# EasyEDA Pro project DualModeKeyboard.eprj (continued)
## Notes on the sheet (continued)
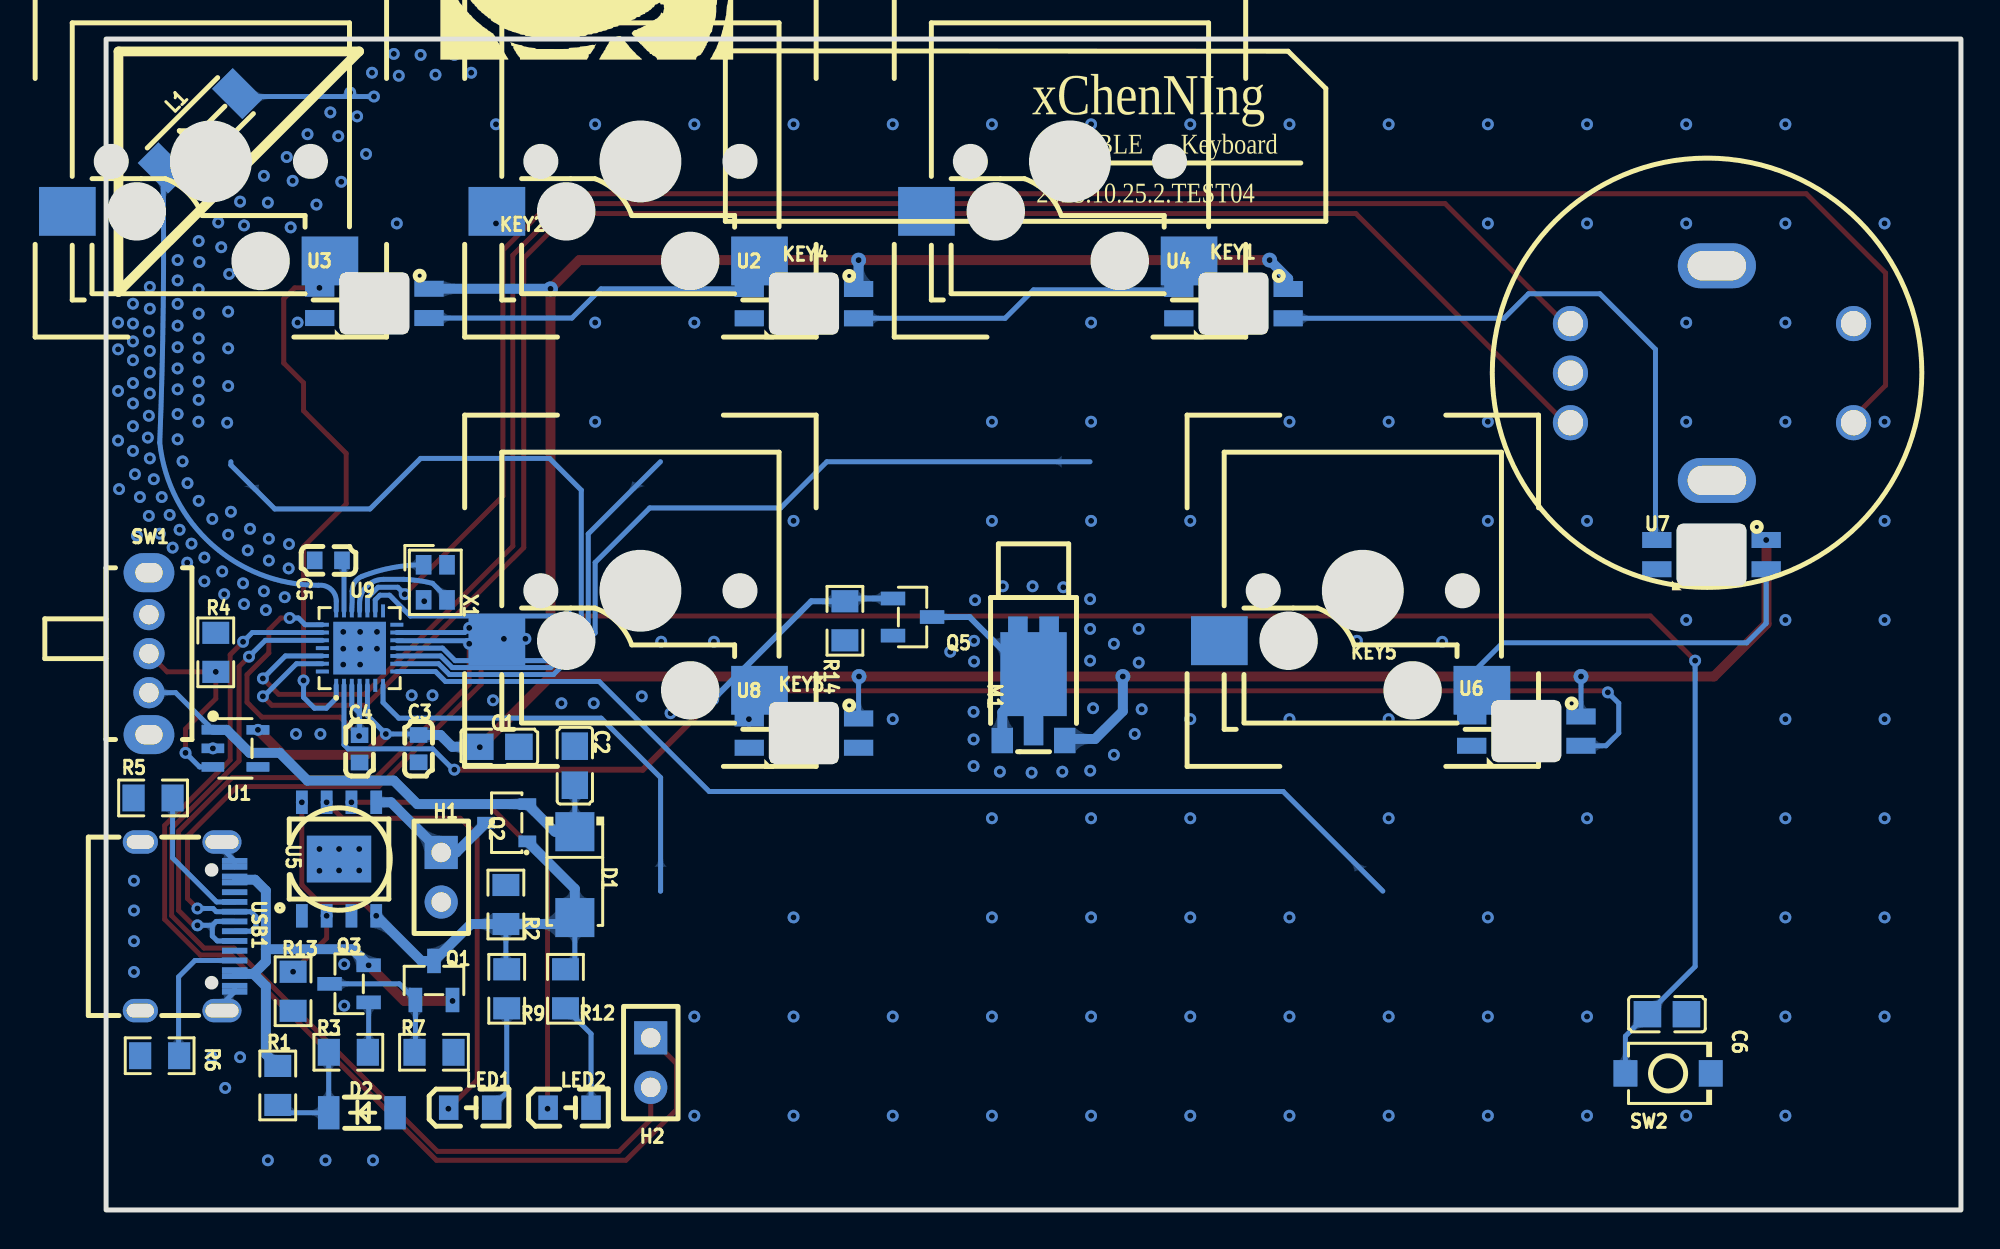
[diagram p2: board, bottom side, seen from below]

Outline 95.63 x 60 mm; copper layers: Top Layer, Bottom Layer. Coordinates in mm from the lower left corner of the outline.
Outline path: rectangle 0,60 95,0
Stack: Top Layer 0.035mm / Dielectric1 1.51mm FR4 er 4.5 / Bottom Layer 0.035mm

## Design rules (mm)
template: JLCPCB Capability(Two Layers Board)
spacing copperThickness1oz (default): track to track 0.102, other pairs 0.152 to 0.3
spacing copperThickness2oz: track to track 0.203, other pairs 0.152 to 0.3
track width copperThickness1oz (default): min 0.127, default 0.254, max 2.54
track width copperThickness2oz: min 0.203, default 0.254, max 2.54
differential pair differentialPair (default): width min 0.127, default 0.254, max 2.54; gap min 0.152, default 0.152
via viaSize (default): diameter min 0.5, default 0.61, max 10; hole min 0.3, default 0.305, max 6.3

## Placement (name value [footprint] x y rotation side)
C1  1uf  [C0805]  74.86 23.73 0 bottom
C2  4.7uf  [C0805]  70.99 22.76 270 bottom
C3  100nF  [C0603]  78.99 23.64 90 bottom
C4  100nF  [C0603]  82.02 23.63 270 bottom
C5  100nF  [C0603]  83.62 33.29 0 bottom
C6  0.1uf  [C0805]  15.06 10.03 0 bottom
D1  SS24  [SMA_L4.3-W2.6-LS5.2-RD]  70.99 17.18 270 bottom
D2  ZMM5V1  [LL-34_L3.5-W1.5-RD]  81.9 4.98 180 bottom
H1  BT_3V7  [HDR-TH_2P-P2.54-V-F]  77.84 17.05 270 bottom
H2  -  [HDR-TH_2P-P2.54-V-F]  67.11 7.55 270 bottom
KEY1  CPG151101S11  [AxisSeat_14_18_XCN1]  46.26 49.9 180 bottom
KEY2  CPG151101S11  [AxisSeat_14_18_XCN1]  90.26 49.9 180 bottom
KEY3  CPG151101S11  [AxisSeat_14_18_XCN1]  68.26 27.9 180 bottom
KEY4  CPG151101S11  [AxisSeat_14_18_XCN1]  68.26 49.9 180 bottom
KEY5  CPG151101S11  [AxisSeat_14_18_XCN1]  31.26 27.9 180 bottom
L1  AN2051-245  [ANT2051]  90.17 55.3 135 bottom
LED1  -  [LED_0805]  76.3 5.24 180 bottom
LED2  -  [LED_0805]  71.21 5.24 180 bottom
M1  Z3OC1T8219731  [VIBRATING-MOTOR-SMD_3P-C9900001680]  47.5 25.58 270 bottom
Q1  FMMT718  [SOT-23-3_L2.9-W1.3-P1.90-LS2.4-BR]  78.21 11.76 270 bottom
Q2  AO3401  [SOT-23-3_L2.9-W1.4-P1.90-LS2.6-BR]  74.48 19.84 180 bottom
Q3  FMMT718  [SOT-23-3_L2.9-W1.3-P1.90-LS2.4-BR]  82.55 11.59 180 bottom
Q5  -  [SOT-23-3_L2.9-W1.3-P1.90-LS2.4-BR]  53.7 30.38 0 bottom
R1  2.2K  [R0805]  86.21 6.38 90 bottom
R2  10K  [R0805]  74.52 15.65 90 bottom
R3  1K  [R0805]  82.59 8.08 0 bottom
R4  100K  [R0805]  89.38 28.57 270 bottom
R5  5.1K  [R0805]  92.59 21.11 180 bottom
R6  5.1K  [R0805]  92.26 7.9 180 bottom
R7  6.8K  [R0805]  78.21 8.08 0 bottom
R9  10K  [R0805]  74.48 11.33 90 bottom
R12  10K  [R0805]  71.47 11.33 90 bottom
R13  2.4K  [R0805]  85.42 11.21 90 bottom
R14  10K  [R0805]  57.16 30.19 90 bottom
SW1  SK12D07VG3  [SW-TH_SK12D07VG3]  92.8 28.51 270 bottom
SW2  TS-1088R-02026  [SW-SMD_L3.9-W3.0-P4.45]  15 7 180 bottom
SW3  EC11E18244AU  [SW-TH_EC11XXXXXXXX]  12.75 42.88 90 top
U1  RT9013-33GB  [SOT-23-5_L3.0-W1.7-P0.95-LS2.8-BL]  88.38 23.65 270 bottom
U2  SK6812MINI-E  [LED-SMD_L3.2-W2.8-TR]  59.26 46.44 180 bottom
U3  SK6812MINI-E  [LED-SMD_L3.2-W2.8-TR]  81.26 46.45 180 bottom
U4  SK6812MINI-E  [LED-SMD_L3.2-W2.8-TR]  37.26 46.44 180 bottom
U5  TP4056  [ESOP-8_L4.9-W3.9-P1.27-LS6.0-BL-EP]  83.07 17.98 180 bottom
U6  SK6812MINI-E  [LED-SMD_L3.2-W2.8-TR]  22.26 24.54 180 bottom
U7  SK6812MINI-E  [LED-SMD_L3.2-W2.8-TR]  12.78 33.58 180 bottom
U8  SK6812MINI-E  [LED-SMD_L3.2-W2.8-TR]  59.26 24.44 180 bottom
U9  CH573F  [QFN-28_L4.0-W4.0-P0.40-BL-EP]  82.02 28.79 180 bottom
USB1  KH-TYPE-C-16P-T  [USB-C-SMD_KH-TYPE-C-16P]  90.83 14.53 270 bottom
X1  32MHz  [OSC-SMD_4P-L2.0-W1.6-BL]  78.14 32.16 270 bottom

## Footprints (pads in the part's own frame, mm; a bottom-side part is the same pattern mirrored in y, then rotated)
ANT2051
  rect 1.5x2.2 smd: 1(-2.69,0) 2(2.69,0)
AxisSeat_14_18_XCN1
  rect 2.9x2.5 smd: 1(-6.725,1.27) 2(6.725,-1.27)
C0603
  rect 0.8x0.9 smd: 1(-0.7,0) 2(0.7,0)
C0805
  rect 1.41x1.35 smd: 1(-1,0) 2(1,0)
ESOP-8_L4.9-W3.9-P1.27-LS6.0-BL-EP
  rect 0.6x1.2 smd: 1(-1.905,-2.909) 2(-0.635,-2.909) 3(0.635,-2.909) 4(1.905,-2.909) 5(1.905,2.909) 6(0.635,2.909) 7(-0.635,2.909) 8(-1.905,2.909)
  rect 3.3x2.4 smd: 9(0,0)
HDR-TH_2P-P2.54-V-F
  rect 1.7x1.7 hole 1: 1(-1.27,0)
  round 1.7 hole 1: 2(1.27,0)
LED-SMD_L3.2-W2.8-TR
  rect 1.5x0.82 smd: 1(2.8,0.75) 2(2.8,-0.75) 3(-2.8,-0.75) 4(-2.8,0.75)
LED_0805
  rect 1x1.25 smd: 1(-1.15,0.005) 2(1.05,0.005)
LL-34_L3.5-W1.5-RD
  rect 1.1x1.7 smd: 1(-1.7,0) 2(1.7,0)
OSC-SMD_4P-L2.0-W1.6-BL
  rect 1x0.8 smd: 1(-0.9,-0.6) 2(0.9,-0.6) 3(0.9,0.6) 4(-0.9,0.6)
QFN-28_L4.0-W4.0-P0.40-BL-EP
  rect 0.2x0.665 smd: 1(-1.2,-1.907) 2(-0.8,-1.907) 3(-0.4,-1.907) 4(0,-1.907) 5(0.4,-1.907) 6(0.8,-1.907) 7(1.2,-1.907) 15(1.2,1.907) 16(0.8,1.907) 17(0.4,1.907) 18(0,1.907) 19(-0.4,1.907) 20(-0.8,1.907) 21(-1.2,1.907)
  rect 0.665x0.2 smd: 8(1.907,-1.2) 9(1.907,-0.8) 10(1.907,-0.4) 11(1.907,0) 12(1.907,0.4) 13(1.907,0.8) 14(1.907,1.2) 22(-1.907,1.2) 23(-1.907,0.8) 24(-1.907,0.4) 25(-1.907,0) 26(-1.907,-0.4) 27(-1.907,-0.8) 28(-1.907,-1.2)
  rect 2.7x2.7 smd: 29(0,0)
R0805
  rect 1.133x1.377 smd: 1(-1,0) 2(1,0)
SMA_L4.3-W2.6-LS5.2-RD
  rect 2x2 smd: 1(-2.2,0) 2(2.2,0)
SOT-23-3_L2.9-W1.3-P1.90-LS2.4-BR
  rect 1.25x0.7 smd: 1(1,-0.95) 2(1,0.95) 3(-1,0)
SOT-23-3_L2.9-W1.4-P1.90-LS2.6-BR
  rect 0.91x0.6 smd: 1(1.055,-0.955) 2(1.055,0.955) 3(-1.055,0)
SOT-23-5_L3.0-W1.7-P0.95-LS2.8-BL
  rect 0.49x1.157 smd: 1(-0.95,-1.153) 2(0,-1.153) 3(0.95,-1.153)
  rect 0.49x1.175 smd: 4(0.95,1.153) 5(-0.95,1.153)
SW-SMD_L3.9-W3.0-P4.45
  rect 1.23x1.36 smd: 1(-2.185,0) 2(2.185,0)
SW-TH_EC11XXXXXXXX
  oval 2.3x4 hole 1.5x3: 6(5.5,0.25) 7(-5.5,0.25)
  round 1.8 hole 1.3: A(-2.54,-7.25) B(2.54,-7.25) C(0,-7.25) D(-2.54,7.25) E(2.54,7.25)
SW-TH_SK12D07VG3
  oval 1.6x1.6 hole 1: 1(-2,0) 2(0,0) 3(2,0)
  oval 2x2.6 hole 1x1.4: 4(4.15,0) 5(-4.15,0)
USB-C-SMD_KH-TYPE-C-16P
  oval 1.2x2 hole 0.7x1.7: 1(-4.32,1.765) 2(4.32,1.765)
  oval 1.2x1.8 hole 0.7x1.4: 3(-4.32,-2.415) 4(4.32,-2.415)
  rect 0.3x1.3 smd: A1(-3.35,2.415) A4(-2.55,2.415) A5(-1.25,2.415) A6(-0.25,2.415) A7(0.25,2.415) A8(1.25,2.415) A9(2.55,2.415) A12(3.35,2.415) B1(3.05,2.415) B4(2.25,2.415) B5(1.75,2.415) B6(0.75,2.415) B7(-0.75,2.415) B8(-1.75,2.415) B9(-2.25,2.415) B12(-3.05,2.415)
VIBRATING-MOTOR-SMD_3P-C9900001680
  rect 1.3x1.1 smd: 1(1.525,1.6) 2(1.525,-1.6)
  custom 0x0 smd: 3(-1.525,0)

## Nets
As in the schematic.

Pads without a net: SW1 1; U1 4; U8 2; U9 6 14 15 25 28; USB1 A8 B8

## Via types
v1: diameter 0.762, hole 0.305, Top Layer to Bottom Layer, 8 vias
v2: diameter 0.61, hole 0.305, Top Layer to Bottom Layer, 297 vias

## Routing (per net, layer and track width the routed paths; a pad name or vN(x,y) marks a point on that pad's centre or on a via; arc(x,y) is an arc through that point)
+5V: length 30.9
  Top Layer w0.254: v2(81.16,15.07) 81.16,15.08 81.84,15.75 84.07,15.75 84.97,16.65 v2(84.97,20.89)
  Bottom Layer w0.254: R2.1 74.52,12.38 R9.2 ; D1.2 70.99,12.81 R12.2
  Bottom Layer w0.508: Q2.1 70.99,16.45 D1.2 71.32,14.65 R2.1 76.32,14.65 Q1.3 78.85,12.76 v2(81.16,15.07)
GND: length 10.1
  Bottom Layer w0.254: USB1.2 89.07,10.53 USB1.A12 USB1.B1 ; USB1.1 89.07,18.53 USB1.A1 USB1.B12 ; v2(81.28,57.05) 88.12,57.05 L1.2
  vias: v2(3.91,50.55) v2(3.91,40.39) v2(3.91,35.31) v2(3.91,30.23) v2(3.91,25.15) v2(3.91,20.07) v2(3.91,14.99) v2(3.91,9.91) v2(8.99,55.63) v2(8.99,50.55) v2(8.99,45.47) v2(8.99,40.39) v2(8.99,30.23) v2(8.99,25.15) v2(8.99,20.07) v2(8.99,14.99) v2(8.99,9.91) v2(8.99,4.83) v2(14.07,55.63) v2(14.07,50.55) v2(14.07,45.47) v2(14.07,40.39) v2(14.07,30.23) v2(14.07,4.83) v2(19.15,55.63) v2(19.15,50.55) v2(19.15,35.31) v2(19.15,20.07) v2(19.15,9.91) v2(19.15,4.83) v2(24.23,55.63) v2(24.23,50.55) v2(24.23,40.39) v2(24.23,35.31) v2(24.23,14.99) v2(24.23,9.91) v2(24.23,4.83) v2(26.57,29.11) v2(29.31,55.63) v2(29.31,40.39) v2(29.31,25.15) v2(29.31,20.07) v2(29.31,9.91) v2(29.31,4.83) v2(30.94,29.16) v2(34.39,55.63) v2(34.39,40.39) v2(34.39,25.15) v2(34.39,14.99) v2(34.39,9.91) v2(34.39,4.83) v2(35.47,29.16) v2(39.47,55.63) v2(39.47,35.31) v2(39.47,25.15) v2(39.47,20.07) v2(39.47,14.99) v2(39.47,9.91) v2(39.47,4.83) v2(41.96,25.66) v2(42.11,29.77) v2(42.11,28.05) v2(42.32,24.39) v2(43.38,29.01) v2(43.38,23.32) v2(44.45,25.71) v2(44.55,55.63) v2(44.55,45.47) v2(44.55,40.39) v2(44.55,35.31) v2(44.6,31.3) v2(44.6,29.77) v2(44.6,28.15) v2(44.6,22.51) v2(44.55,20.07) v2(44.55,14.99) v2(44.55,9.91) v2(44.55,4.83) v2(45.97,31.91) v2(46.03,22.46) v2(47.55,31.96) v2(47.6,22.41) v2(49.07,31.96) v2(49.22,22.46) v2(49.63,55.63) v2(49.63,40.39) v2(49.63,35.31) v2(49.63,20.07) v2(49.63,14.99) v2(49.63,9.91) v2(49.63,4.83) v2(50.5,31.25) v2(50.55,29.16) v2(50.55,28.1) v2(50.57,25.52) v2(50.57,24.11) v2(50.57,22.75) v2(51.76,28.61) v2(54.71,55.63) v2(54.71,25.15) v2(54.71,9.91) v2(54.71,4.83) v2(59.79,55.63) v2(59.79,35.31) v2(59.79,14.99) v2(59.79,9.91) v2(59.79,4.83) v2(63.87,29.12) v2(64.87,55.63) v2(64.87,45.47) v2(64.87,9.91) v2(64.87,4.83) v2(66.09,25.46) v2(66.57,29.12) v2(67.56,26.32) v2(69.95,55.63) v2(69.95,45.47) v2(69.95,40.39) v2(70.02,25.96) v2(71.68,25.96) v2(73.52,29.27) v2(74.62,29.27) v2(75.03,55.63) v2(75.03,50.55) v2(75.18,26.12) v2(76.3,58.27) v2(77.16,59.19) v2(78.13,58.17) v2(78.28,26.37) v2(78.71,31.19) v2(78.89,59.19) v2(79.35,26.37) v2(80.01,58.12) v2(80.11,50.55) v2(80.26,59.24) v2(81.13,29.62) v2(81.13,28.76) v2(81.33,2.54) v2(81.38,58.27) v2(81.69,54.11) v2(81.99,29.62) v2(81.99,28.76) v2(81.99,27.94) v2(82.04,18.5) v2(82.04,17.4) v2(82.14,56.04) v2(82.5,57.26) v2(82.8,12.59) v2(82.8,10.47) v2(82.85,29.62) v2(82.85,28.76) v2(82.85,27.94) v2(82.96,52.69) v2(83.11,55.02) v2(83.07,18.5) v2(83.07,17.4) v2(83.51,56.24) v2(83.76,2.54) v2(84.02,24.39) v2(84.07,18.5) v2(84.07,17.38) v2(84.18,53.85) v2(84.23,51.52) v2(84.68,55.12) v2(85.19,45.47) v2(85.27,24.39) v2(85.45,52.74) v2(85.55,50.35) v2(85.63,34.12) v2(85.65,32.87) v2(85.75,53.95) v2(85.85,31.4) v2(86.72,51.62) v2(86.66,34.4) v2(86.66,33.28) v2(86.71,2.54) v2(86.82,30.74) v2(86.92,52.99) v2(86.92,31.7) v2(87.02,49.13) v2(87.63,34.91) v2(87.75,33.8) v2(87.94,50.45) v2(87.94,31.04) v2(87.99,32.11) v2(88.14,51.67) v2(88.14,7.83) v2(88.61,35.78) v2(88.7,47.96) v2(88.75,46.03) v2(88.75,44.15) v2(88.75,42.22) v2(88.75,34.6) v2(88.8,40.34) v2(88.9,6.25) v2(88.95,31.55) v2(89.1,49.33) v2(89.05,32.72) v2(89.26,50.6) v2(89.53,23.65) v2(89.56,35.41) v2(89.59,7.83) v2(89.97,33.43) v2(89.97,32.21) v2(90.22,48.57) v2(90.26,49.65) v2(90.26,47.18) v2(90.26,45.93) v2(90.26,44.66) v2(90.26,43.67) v2(90.26,42.45) v2(90.26,41.51) v2(90.27,40.39) v2(90.26,36.34) v2(90.63,34.14) v2(90.83,37.24) v2(90.85,33.17) v2(91.08,38.36) v2(91.24,34.85) v2(91.34,48.67) v2(91.34,47.63) v2(91.34,46.43) v2(91.34,45.31) v2(91.34,44.21) v2(91.34,43.12) v2(91.34,42.05) v2(91.34,40.78) v2(91.34,39.49) v2(91.59,33.94) v2(91.75,35.62) v2(92.15,36.53) v2(92.25,34.65) v2(92.56,37.44) v2(92.76,47.3) v2(92.76,46.18) v2(92.81,45.01) v2(92.76,44.02) v2(92.76,42.91) v2(92.76,41.84) v2(92.81,40.7) v2(92.76,38.51) v2(92.81,35.56) v2(92.86,39.58) v2(93.27,36.53) v2(93.42,34.55) v2(93.52,37.7) v2(93.62,46.44) v2(93.62,45.42) v2(93.62,44.51) v2(93.62,43.54) v2(93.62,42.37) v2(93.62,41.33) v2(93.62,40.16) v2(93.62,38.9) v2(93.57,16.87) v2(93.57,15.35) v2(93.57,13.77) v2(93.57,12.2) v2(94.34,36.94) v2(94.39,45.47) v2(94.39,44.1) v2(94.39,41.97) v2(94.39,39.43)
VBUS: length 23.5
  Top Layer w0.508: v2(77.26,10.71) 79.73,10.71 v2(81.55,12.54)
  Bottom Layer w0.254: USB1.A9 USB1.B4 ; USB1.A4 USB1.B9
  Bottom Layer w0.508: 87.45,12.1 86.82,11.47 86.82,7.99 R1.2 ; 87.45,12.1 86.82,12.72 86.82,13.36 ; 87.45,12.1 88.3,12.1 ; 86.82,13.36 86.82,16.36 87.38,16.92 88.25,16.92 ; 86.82,13.36 82.38,13.36 v2(81.55,12.54)
VCC: length 164.8
  Top Layer w0.508: 72.24,27.34 72.24,47.2 70.76,48.67 v1(56.46,48.67) v1(35.41,48.67) ; 72.24,27.34 v1(75.86,23.71) ; 72.24,27.34 v1(56.44,27.34) v1(42.93,27.34) v1(19.46,27.34) 12.65,27.34 9.96,30.03 9.96,34.31 v2(9.98,34.33) ; v2(80.67,24.39) 80.67,24.34 81.69,23.32 85.94,23.32 v2(87.22,24.6)
  Bottom Layer w0.254: U6.1 v1(19.46,27.34) ; C3.2 79.04,24.39 v2(80.67,24.39) 81.62,25.33 U9.5 ; v1(56.44,27.34) 56.46,27.32 56.46,25.19
  Bottom Layer w0.508: U3.1 72.24,47.2 v1(72.24,47.2) ; M1.1 45.82,24.14 44.35,24.14 42.93,25.56 v1(42.93,27.34) ; v1(35.41,48.67) 34.46,47.72 U4.1 ; C3.2 77.88,24.34 77.27,23.73 C1.2 ; 56.46,47.19 v1(56.46,48.67)
BAT: length 7.3
  Bottom Layer w0.508: Q2.3 77.06,18.32 H1.1 80.41,20.89 U5.5
KEY_C: length 21
  Bottom Layer w0.254: 80.11,28.39 77.87,28.39 77.27,27.79 72.24,27.79 70.31,29.72 70.31,34.64 66.61,38.34
KEY_CTRL: length 55.2
  Bottom Layer w0.254: U9.8 78.13,27.59 77.62,27.08 69.75,27.08 64.11,21.44 34.71,21.44 29.61,16.34
KEY_ENTER: length 22.5
  Bottom Layer w0.254: 66.61,16.34 66.6,16.35 66.6,22.15 69.65,25.2 80.01,25.2 80.82,26.01 U9.7
KEY_V: length 38.2
  Bottom Layer w0.254: 88.61,38.34 88.61,38.17 86.36,35.92 81.48,35.92 78.89,38.51 72.29,38.51 70.66,36.89 70.66,29.87 72.38,28.15 77.12,28.15 77.77,28.79 U9.11
KEY_X: length 42.4
  Bottom Layer w0.254: 80.11,27.99 77.97,27.99 77.42,27.44 72.09,27.44 69.95,29.57 69.95,33.18 67.16,35.97 60.45,35.97 58.08,38.34 44.61,38.34
PWM: length 35.3
  Top Layer w0.305: v2(63.91,26.17) 67.51,22.56 v2(77.16,22.56)
  Bottom Layer w0.254: v2(77.16,22.56) 77.21,22.56 78.28,23.63 82.6,23.63 82.82,23.84 U9.2
  Bottom Layer w0.305: Q5.1 57.02,31.33 R14.2 58.88,31.19 v2(63.91,26.17)
RGB_LED: length 27.5
  Top Layer w0.254: v2(84.07,47.25) 85.34,47.25 85.9,46.69 85.9,43.4 84.89,42.38 84.89,40.95 82.7,38.77 82.7,36.17 84.89,33.99 v2(84.89,27.13)
  Bottom Layer w0.254: v2(84.89,27.13) 84.89,26.27 84.33,25.71 83.72,25.71 83.22,26.21 U9.1 ; v2(84.07,47.25) 84.06,47.23 U3.4
ROLLER_A: length 94.2
  Top Layer w0.254: v2(86.97,26.32) 86.51,25.86 81.69,25.86 73.61,33.94 73.61,48.77 71.32,51.06 30.99,51.06 20.27,40.34
  Bottom Layer w0.254: 83.92,27.99 85.25,27.99 86.92,26.32 v2(86.97,26.32)
ROLLER_B: length 92.3
  Top Layer w0.254: 20.27,45.42 26.42,51.57 71.53,51.57 74.17,48.93 74.17,34.02 81.76,26.42 86.16,26.42 v2(86.97,27.23)
  Bottom Layer w0.254: v2(86.97,27.23) 85.81,28.39 83.92,28.39
ROLLER_BT: length 104.8
  Top Layer w0.254: v2(79.71,31.55) 74.68,36.58 74.68,49.18 71.78,52.08 7.92,52.08 3.86,48.01 3.86,42.25 5.77,40.34
  Bottom Layer w0.254: U9.17 81.62,31.36 81.07,31.91 80.06,31.91 v2(79.71,31.55)
RST_BT: length 92.3
  Top Layer w0.254: v2(13.61,28.15) 15.9,30.43 v2(71.37,30.43)
  Bottom Layer w0.254: v2(71.37,30.43) 79.41,30.43 80.48,31.5 80.97,31.5 81.22,31.26 U9.16 ; v2(13.61,28.15) 13.61,12.47 C6.2 17.19,8.9 SW2.1
RX: length 56.8
  Top Layer w0.254: H2.1 65.79,7.5 65.79,5.14 68.38,2.54 78.07,2.54 88.59,13.06 90.17,13.06 92,14.89 92,19.71 88.65,23.06 88.65,28.45 v2(87.99,29.11)
  Bottom Layer w0.254: v2(87.99,29.11) 87.51,29.59 U9.23
TX: length 50.9
  Top Layer w0.254: v2(87.68,28.35) 88.19,27.84 88.19,23.01 91.64,19.56 91.64,15.08 89.98,13.42 88.44,13.42 78.03,3 68.73,3 67.11,4.63 H2.2
  Bottom Layer w0.254: U9.24 86.84,29.19 v2(87.68,28.35)
USB_D+: length 33
  Top Layer w0.254: v2(90.32,14.58) 90.53,14.58 91.29,15.35 91.29,19.41 88.54,22.15 81.18,22.15 76.4,26.93 v2(76.4,29.01)
  Bottom Layer w0.254: USB1.A6 89.36,14.78 89.56,14.58 ; 89.56,14.58 89.56,14.04 89.31,13.78 USB1.B6 ; 89.56,14.58 v2(90.32,14.58) ; 80.09,29.17 76.56,29.17 v2(76.4,29.01)
USB_D-: length 34.2
  Top Layer w0.254: v2(90.32,15.45) 90.83,15.96 90.83,19.16 88.29,21.7 81.04,21.7 75.79,26.94 75.79,29.52 76.1,29.83 v2(76.4,29.83)
  Bottom Layer w0.254: v2(76.4,29.83) 76.64,29.59 U9.13 ; v2(90.32,15.45) 89.52,15.45 89.36,15.28 USB1.B7 87.58,15.28 87.32,15.03 87.32,14.54 87.58,14.28 USB1.A7
V(SLT): length 27.1
  Bottom Layer w0.254: U1.1 91.44,26.51 SW1.3 ; D1.1 C2.2
  Bottom Layer w0.508: U1.1 88.83,24.6 87.65,23.42 86.11,23.42 84.68,22 80.26,22 79.06,20.8 Q2.2 72.01,19.38 D1.1
$1N588: length 2.6
  Bottom Layer w0.254: U9.20 82.82,33.19 C5.1
$1N5446: length 7.2
  Bottom Layer w0.254: USB1.A5 89.34,15.78 91.59,18.04 R5.2
$1N5462: length 7.3
  Bottom Layer w0.254: USB1.B5 90.45,12.78 91.29,11.94 91.29,7.94 R6.2
$1N6903: length 10.3
  Top Layer w0.254: SW1.2 91.87,27.57 v2(89.38,27.57) 89.38,26.2 90.93,24.65 v2(90.93,23.42)
  Bottom Layer w0.254: v2(90.93,23.42) 90.21,22.7 U1.3
$1N8513: length 23.1
  Top Layer w0.254: v2(83.7,20.89) 82.89,20.07 76.86,20.07 76,19.21 76,6.66 v2(77.47,5.19)
  Bottom Layer w0.254: 77.45,5.24 77.47,5.22 v2(77.47,5.19)
$1N8523: length 24
  Top Layer w0.254: v2(72.39,5.19) 72.39,17.73 75.55,20.89 v2(82.43,20.89)
  Bottom Layer w0.254: 72.36,5.24 72.36,5.22 v2(72.39,5.19)
$1N8602: length 5.4
  Bottom Layer w0.254: R9.1 74.48,6.01 75.25,5.24
$1N8604: length 5.6
  Bottom Layer w0.254: R12.1 70.16,9.02 70.16,5.24
$1N8691: length 3.6
  Top Layer w0.254: v2(83.7,15.07) 83.7,13.93 v2(85.42,12.21)
$1N9465: length 18.1
  Top Layer w0.254: v2(82.04,24.29) 83.01,25.25 87.02,25.25 87.78,26.02 87.78,27.42 86.66,28.54 86.66,29.72 86.06,30.33 v2(85.6,30.33)
  Bottom Layer w0.254: U9.4 82.02,25.46 ; 82.02,25.46 82.02,24.31 82.04,24.29 ; 82.02,25.46 82.42,25.86 U9.3 ; 83.92,29.99 84.8,29.99 85.15,30.33 v2(85.6,30.33) 85.7,30.33
$1N9696: length 6
  Bottom Layer w0.254: U9.18 82.02,31.09 arc(81.66,31.96) 80.79,32.31 79.74,32.31 arc(79.01,32.25) 78.28,32.11 77.61,31.44 arc(77.56,31.36) X1.3
$1N9702: length 5.2
  Bottom Layer w0.254: U9.19 arc(82.4,31.2) 82.4,31.7 arc(82.26,32.17) 81.89,32.47 arc(80.34,32.91) X1.1
$1N12595: length 5.9
  Bottom Layer w0.254: R3.2 83.6,8.07 D2.1 85.81,4.98 R1.1
$1N12597: length 2.6
  Bottom Layer w0.254: Q3.1 81.55,8.12 R3.1
$1N12605: length 7.4
  Bottom Layer w0.254: Q3.3 79.98,11.59 Q1.1 79.16,8.13 R7.2
$1N13146: length 27.9
  Bottom Layer w0.254: U9.21 83.21,31.2 arc(83.49,31.81) 84.12,32.01 arc(89.59,34.11) 92.25,39.32 arc(92.07,46.36) 92.09,53.4
$1N19892: length 17
  Bottom Layer w0.254: U3.2 71.14,45.7 69.65,47.2 62.07,47.2 U2.4
$1N19911: length 21.1
  Bottom Layer w0.254: U6.4 25.09,25.32 25.09,27.44 23.47,29.06 10.97,29.06 9.98,30.06 U7.2
$1N19914: length 49.7
  Top Layer w0.254: v2(18.08,26.52) 18.16,26.6 61.44,26.6 62.08,25.96 v1(62.08,25.15)
  Bottom Layer w0.254: U6.2 18.18,23.79 17.53,24.44 17.53,25.96 v2(18.08,26.52) ; U8.4 62.06,25.17 v1(62.08,25.15)
$1N19980: length 17
  Bottom Layer w0.254: U4.4 40.1,47.15 47.5,47.15 48.96,45.69 56.46,45.69
$1N19985: length 30.3
  Bottom Layer w0.254: U4.2 23.4,45.69 22.15,46.94 18.49,46.94 15.65,44.1 15.65,34.4 U7.4
$1N28669: length 10.3
  Bottom Layer w0.305: Q5.3 50.78,30.38 M1.3
  Bottom Layer w0.508: M1.2 49.1,25.51 M1.3

## Copper pours and planes (outline as drawn; the poured copper is in the pictures)
GND on Top Layer: 0,60 80.45,60 95,45.45 95,-4.84 -0.03,-4.84 -0.05,-4.82 0.05,-4.72 0.05,-4.26 0.31,-4.01
GND on Bottom Layer: 0,60 80.43,60 95,45.43 95,-10.41 0.1,-10.41 -0.05,-10.26 -0.97,-10.26 -1.17,-10.05

Small or netless copper shapes (teardrops, artwork), in the pictures only: 50 on Top Layer, 121 on Bottom Layer

## Text on the board
Bottom Silkscreen Layer: Keyboard | USB/BLE | 2023.10.25.2.TEST04 | xChenNIng
Top Silkscreen Layer: Keyboard | 2023.10.25.2.TEST04 | USB/BLE | xChenNIng
